# EasyEDA Pro project Archive.eprj, board ALU4.0
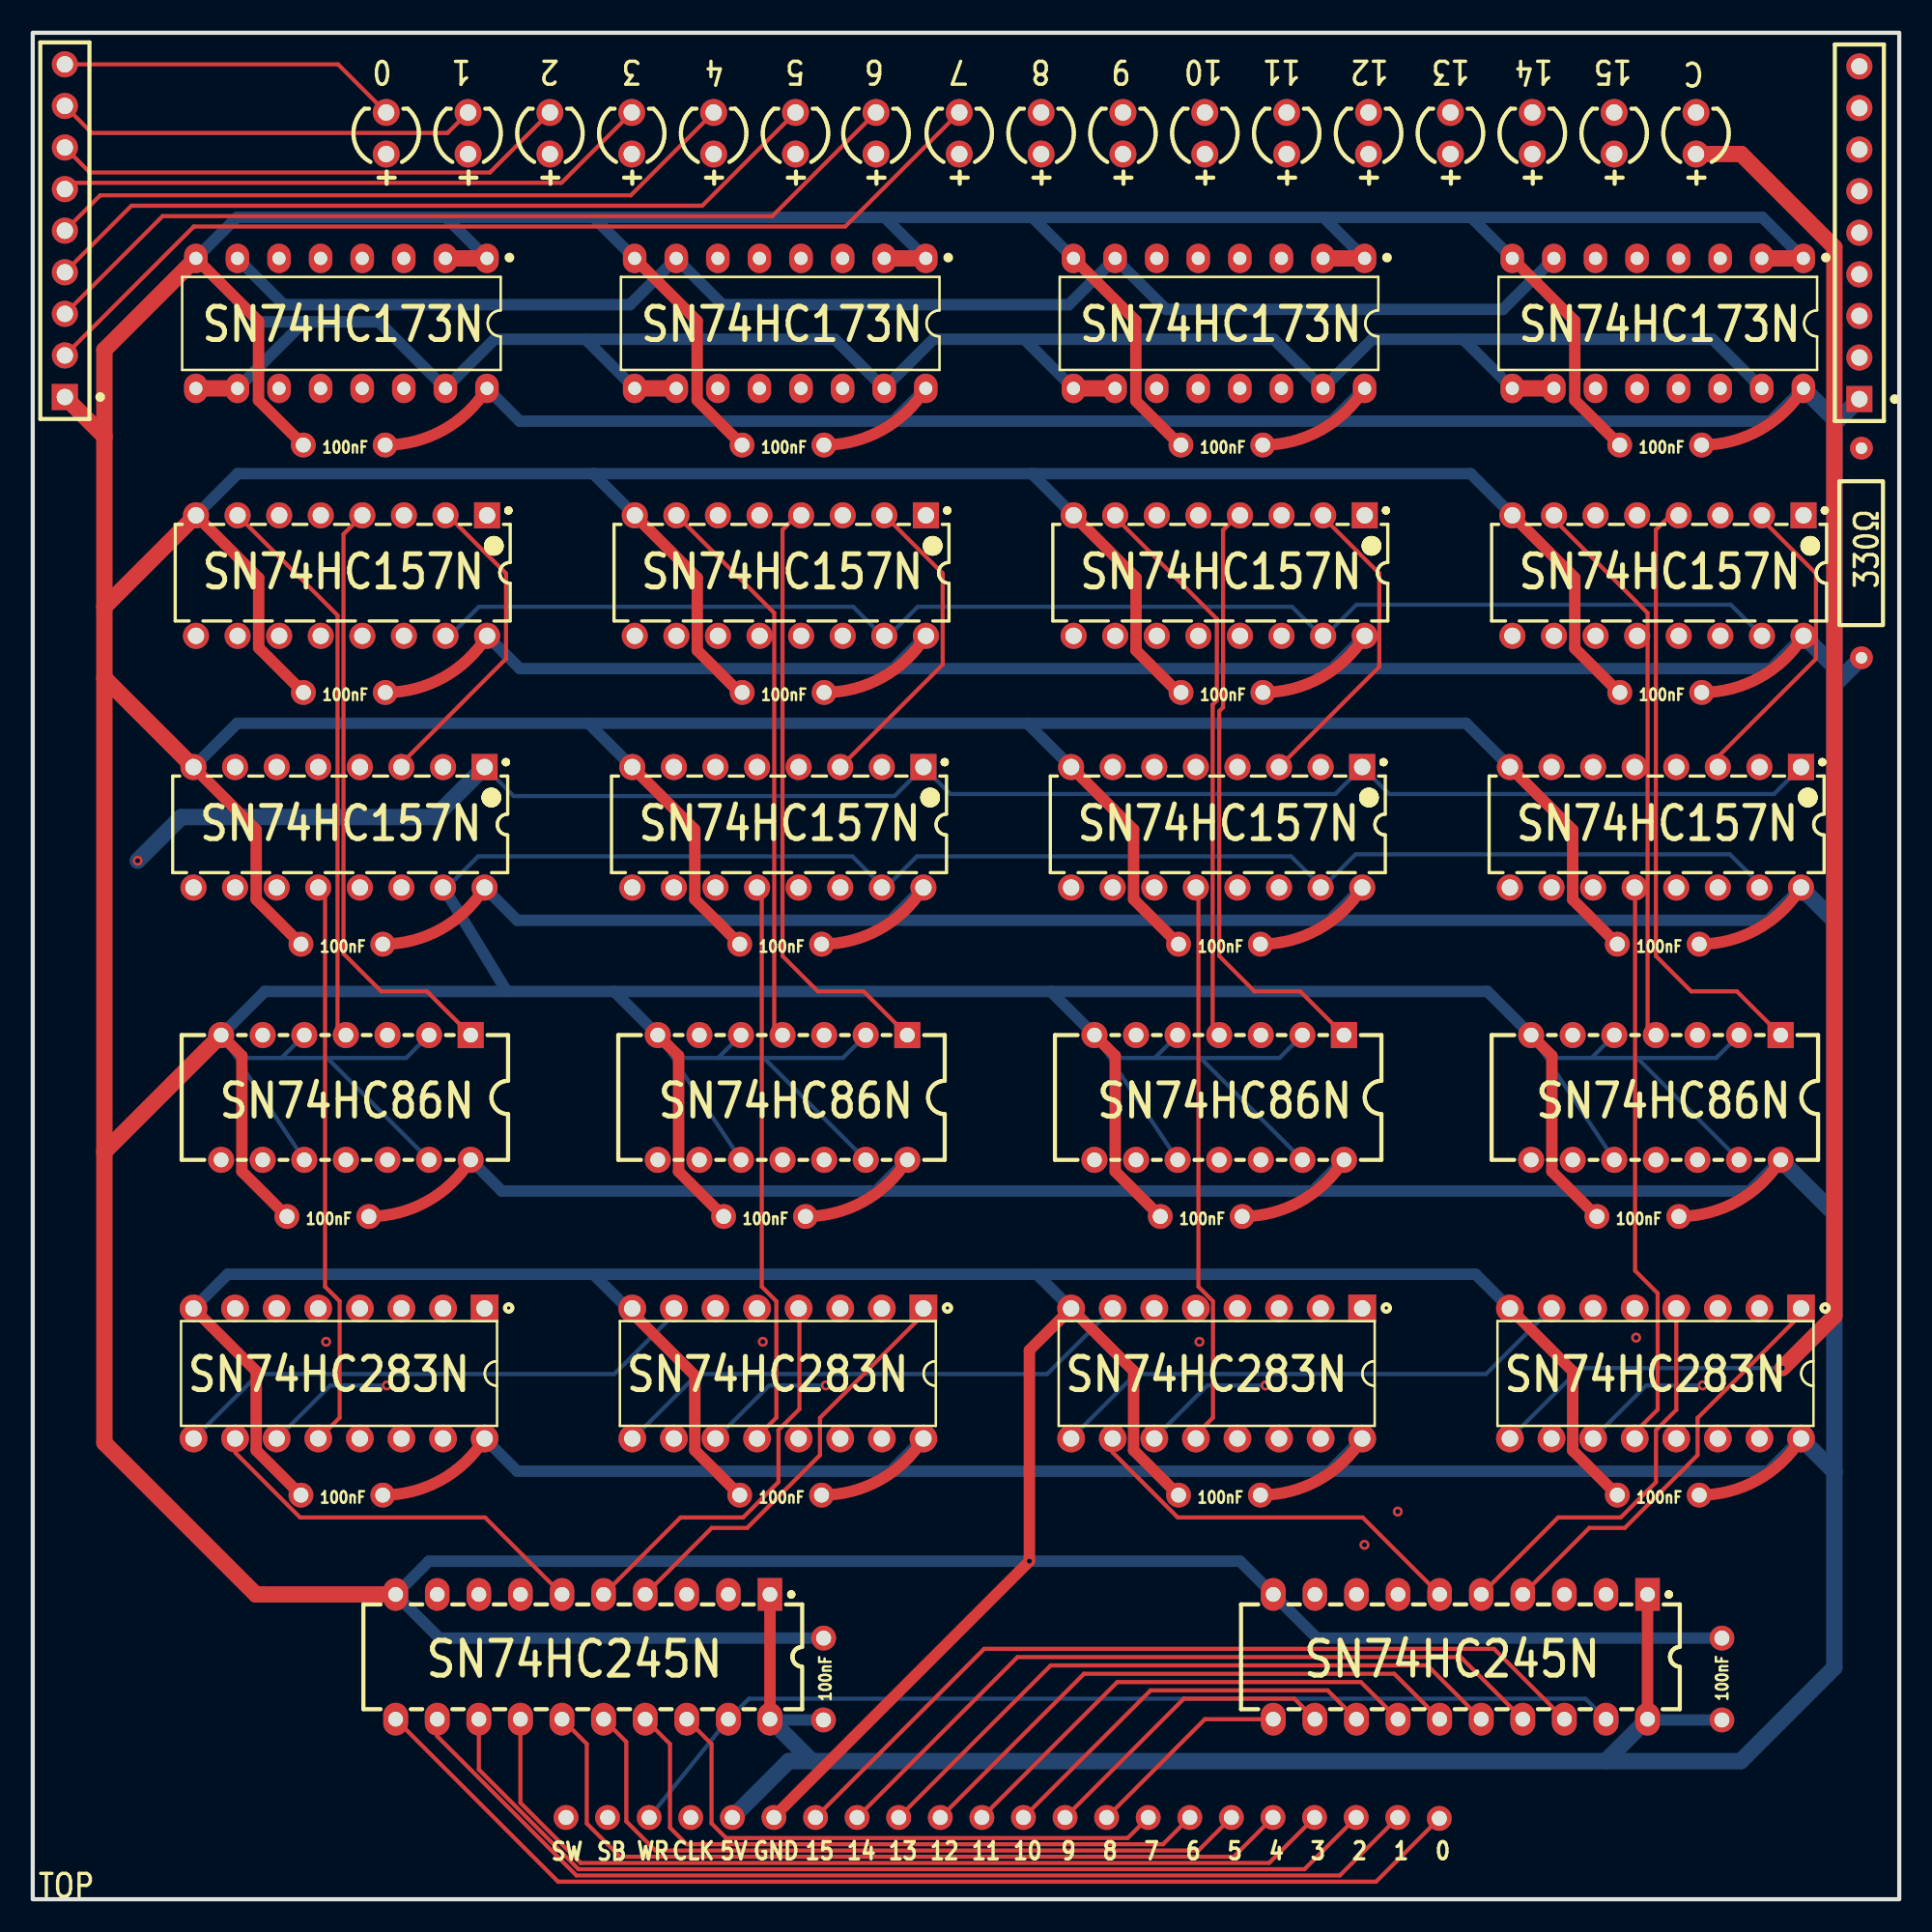
[diagram p18: board, top side]
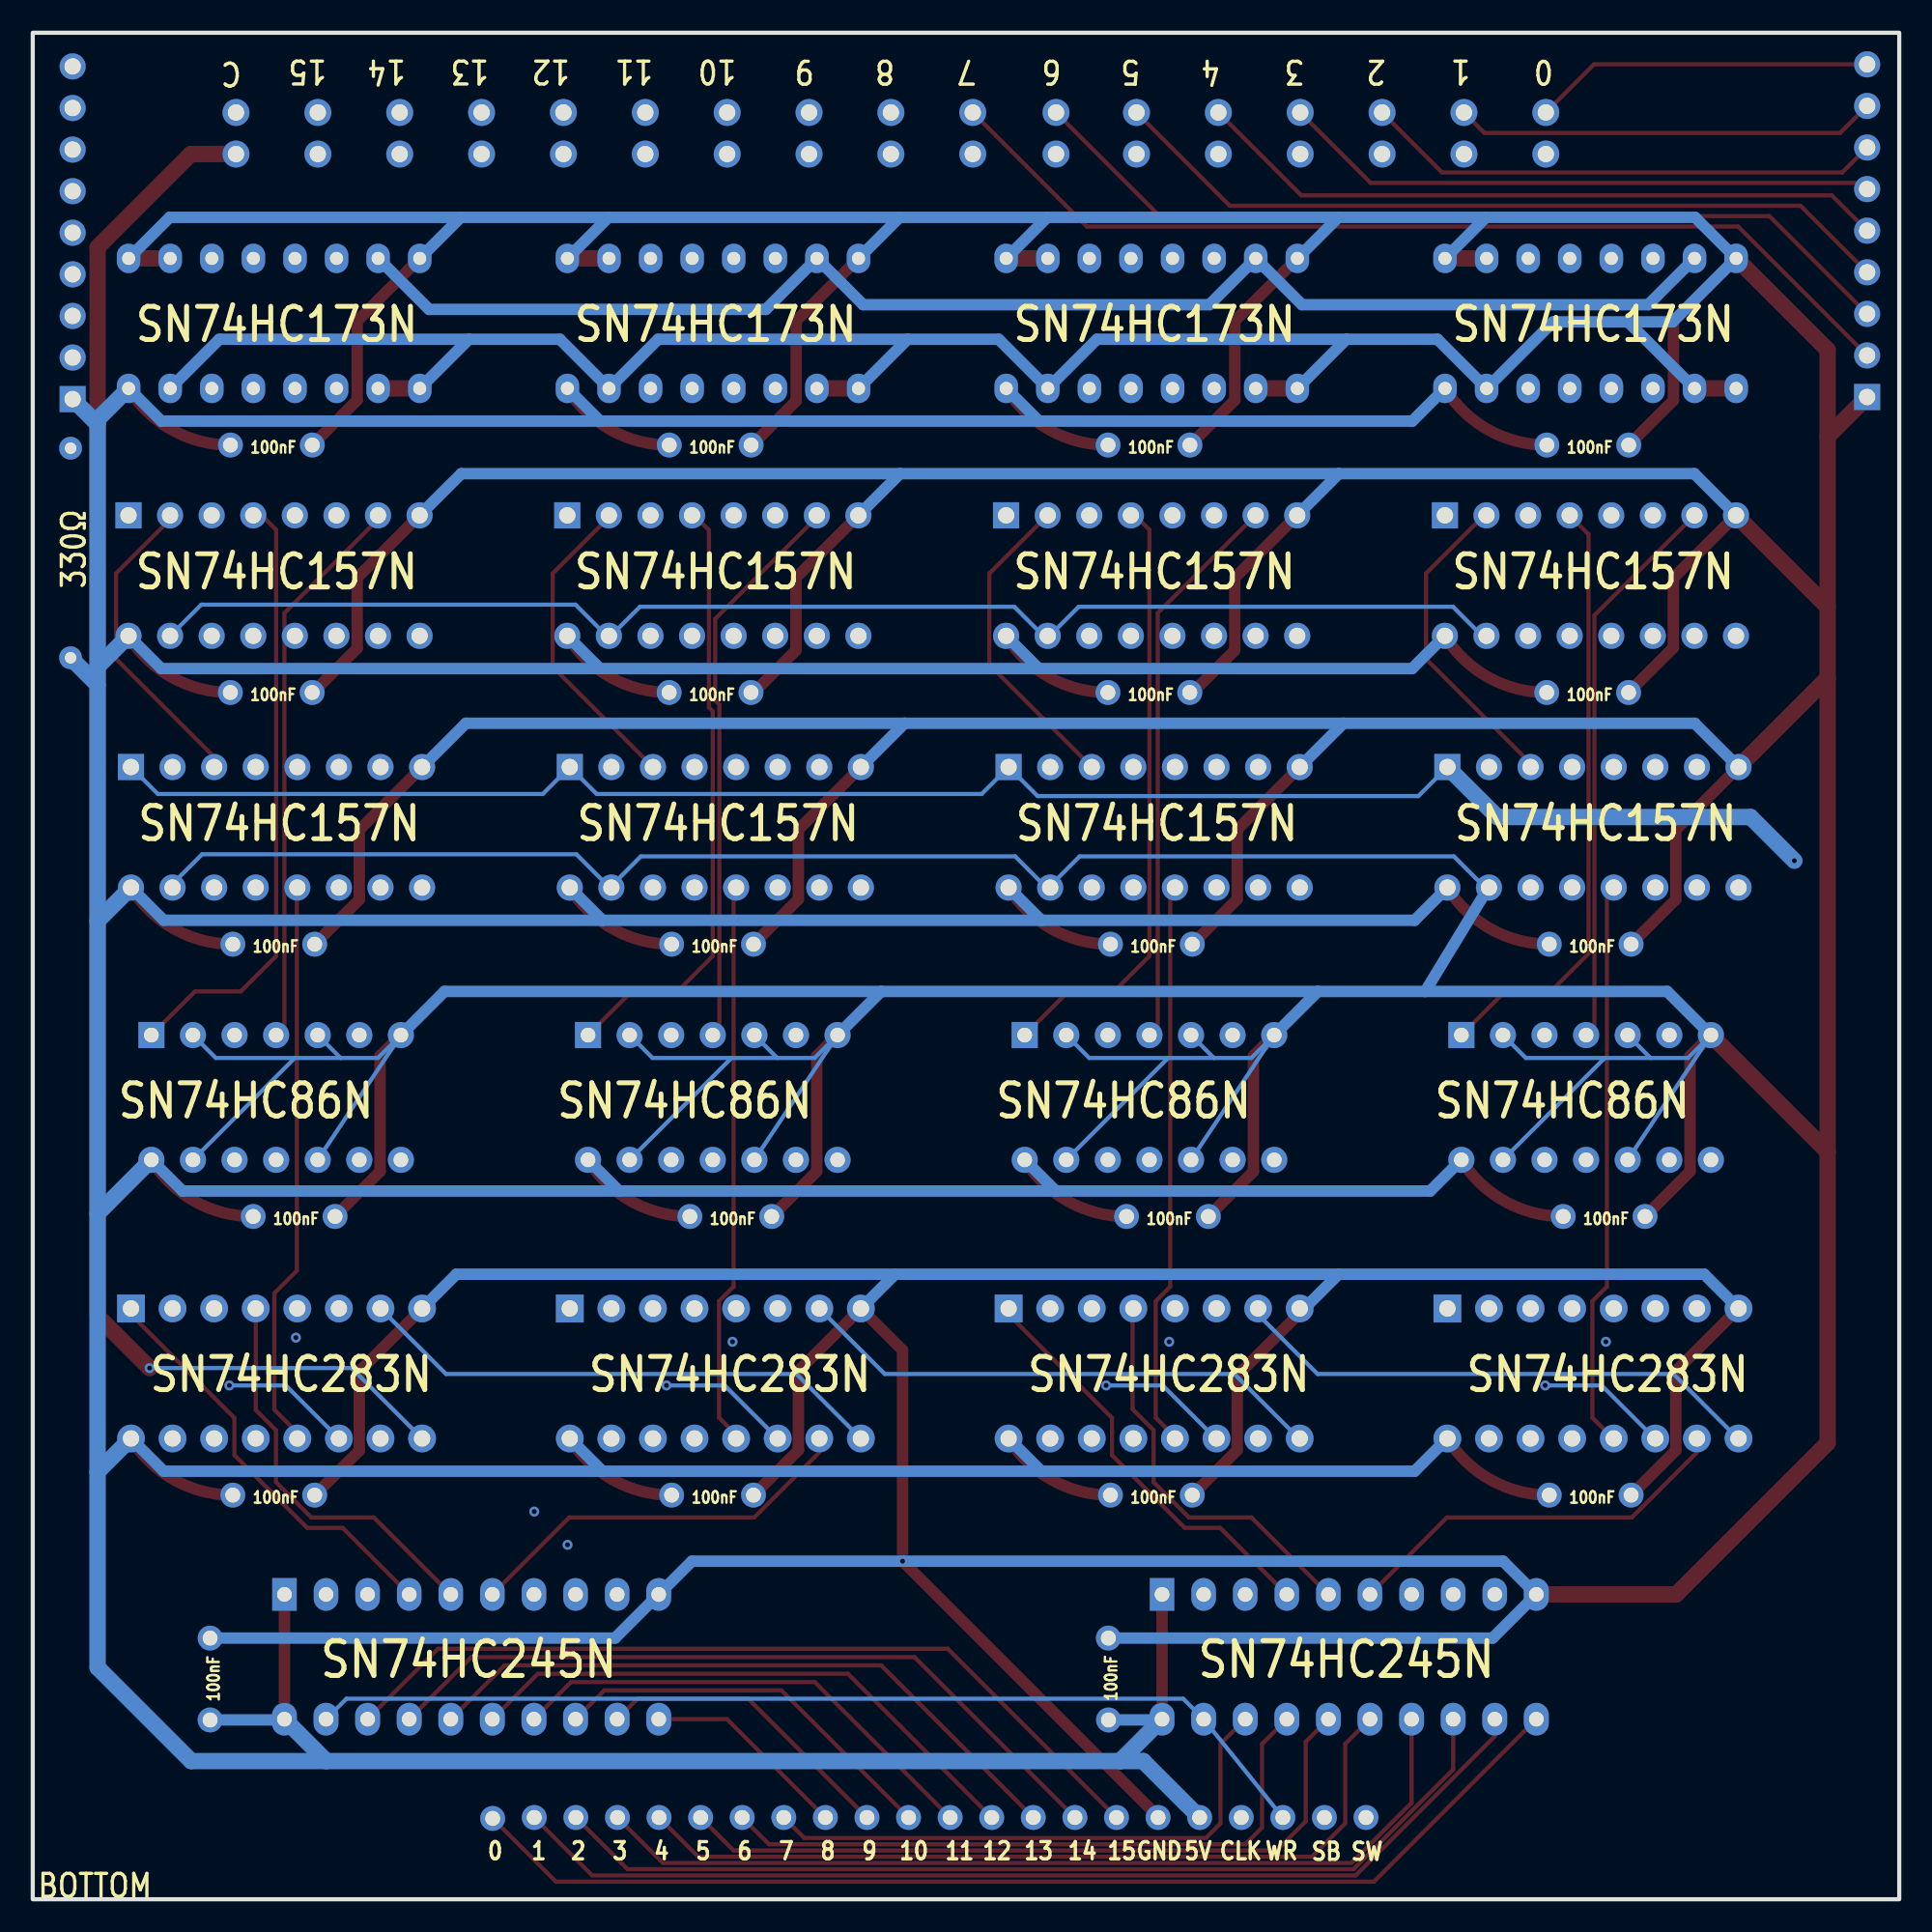
[diagram p19: board, bottom side, seen from below]

Outline 114 x 114 mm; copper layers: Top Layer, Inner1, Inner2, Bottom Layer. Coordinates in mm from the lower left corner of the outline.
Outline path: rectangle 0,114 114,0
Stack: Top Layer 0.035mm / Dielectric1 1.51mm FR4 er 4.5 / Inner1 0.035mm / Dielectric2 0.48mm PP er 4.5 / Inner2 0.035mm / Dielectric3 0.48mm PP er 4.5 / Bottom Layer 0.035mm

## Design rules (mm)
template: JLCPCB Capability(Two Layers Board)
spacing copperThickness1oz (default): track to track 0.102, other pairs 0.152 to 0.3
spacing copperThickness2oz: track to track 0.203, other pairs 0.152 to 0.3
track width copperThickness1oz (default): min 0.127, default 0.254, max 2.54
track width copperThickness2oz: min 0.203, default 0.254, max 2.54
differential pair differentialPair (default): width min 0.127, default 0.254, max 2.54; gap min 0.152, default 0.152
via viaSize (default): diameter min 0.5, default 0.61, max 10; hole min 0.3, default 0.305, max 6.3

## Placement (name value [footprint] x y rotation side)
NOREF  -  [Pad_e1063]  20.53 41.7 270 top
NOREF#2  -  [Pad_e681]  55.43 4.99 90 top
NOREF#3  -  [Pad_e1045]  96.93 73.71 270 top
NOREF#4  -  [Pad_e658]  42.73 4.99 0 top
NOREF#5  -  [Pad_e736]  85.91 4.94 90 top
NOREF#6  -  [Pad_e1047]  96.78 58.33 270 top
NOREF#7  -  [Pad_e1040]  103.17 15.95 0 top
NOREF#8  -  [Pad_e1050]  43.18 24.68 270 top
NOREF#9  -  [Pad_e1046]  96.93 88.82 270 top
NOREF#10  -  [Pad_e1073]  74.98 58.33 270 top
NOREF#11  -  [Pad_e1049]  95.54 41.7 270 top
NOREF#12  -  [Pad_e616]  35.11 4.99 0 top
NOREF#13  -  [Pad_e1055]  48.32 88.82 270 top
NOREF#14  -  [Pad_e1053]  48.3 15.95 180 top
NOREF#15  -  [Pad_e688]  63.05 4.99 90 top
NOREF#16  -  [Pad_e1069]  43.33 73.71 270 top
NOREF#17  -  [Pad_e1071]  43.18 58.33 270 top
NOREF#18  -  [Pad_e1083]  75.13 88.82 270 top
NOREF#19  -  [Pad_e656]  40.19 4.99 0 top
NOREF#20  -  [Pad_e1060]  21.52 88.82 270 top
NOREF#21  -  [Pad_e733]  80.83 4.99 90 top
NOREF#22  -  [Pad_e1054]  48.33 73.71 270 top
NOREF#23  -  [Pad_e1057]  48.18 58.33 270 top
NOREF#24  -  [Pad_e1041]  101.93 73.71 270 top
NOREF#25  -  [Pad_e1072]  74.98 24.68 270 top
NOREF#26  -  [Pad_e1052]  48.29 10.95 0 top
NOREF#27  -  [Pad_e1064]  16.53 73.71 270 top
NOREF#28  -  [Pad_e705]  70.67 4.99 90 top
NOREF#29  -  [Pad_e1074]  73.87 41.7 270 top
NOREF#30  -  [Pad_e1076]  68.87 41.7 270 top
NOREF#31  -  [Pad_e1080]  70.13 88.82 270 top
NOREF#32  -  [Pad_e1082]  75.13 73.71 270 top
NOREF#33  -  [Pad_e1075]  69.98 24.68 270 top
NOREF#34  -  [Pad_e719]  73.21 4.99 90 top
NOREF#35  -  [Pad_e1056]  48.18 24.68 270 top
NOREF#36  -  [Pad_e1065]  16.52 88.82 270 top
NOREF#37  -  [Pad_e1081]  69.98 58.33 270 top
NOREF#38  -  [Pad_e1048]  96.78 24.68 270 top
NOREF#39  -  [Pad_e661]  45.27 4.99 90 top
NOREF#40  -  [Pad_e1044]  100.54 41.7 270 top
NOREF#41  -  [Pad_e1067]  16.38 58.33 270 top
NOREF#42  -  [Pad_e613]  32.57 4.99 0 top
NOREF#43  -  [Pad_e1062]  21.38 58.33 270 top
NOREF#44  -  [Pad_e695]  68.13 4.99 90 top
NOREF#45  -  [Pad_e734]  83.37 4.99 90 top
NOREF#46  -  [Pad_e1070]  43.32 88.82 270 top
NOREF#47  -  [Pad_e1038]  101.78 24.68 270 top
NOREF#48  -  [Pad_e1042]  101.93 88.82 270 top
NOREF#49  -  [Pad_e1058]  47.2 41.7 270 top
NOREF#50  -  [Pad_e1068]  15.53 41.7 270 top
NOREF#51  -  [Pad_e1051]  42.2 41.7 270 top
NOREF#52  -  [Pad_e620]  37.65 4.99 0 top
NOREF#53  -  [Pad_e1043]  101.78 58.33 270 top
NOREF#54  -  [Pad_e1061]  21.38 24.68 270 top
NOREF#55  -  [Pad_e686]  60.51 4.99 90 top
NOREF#56  -  [Pad_e689]  65.59 4.99 90 top
NOREF#57  -  [Pad_e685]  57.97 4.99 90 top
NOREF#58  -  [Pad_e680]  52.89 4.99 90 top
NOREF#59  -  [Pad_e732]  78.29 4.99 90 top
NOREF#60  -  [Pad_e1066]  16.38 24.68 270 top
NOREF#61  -  [Pad_e1079]  70.13 73.71 270 top
NOREF#62  -  [Pad_e664]  47.81 4.99 90 top
NOREF#63  -  [Pad_e676]  50.35 4.99 90 top
NOREF#64  -  [Pad_e1059]  21.53 73.71 270 top
NOREF#65  -  [Pad_e722]  75.75 4.99 90 top
NOREF#66  -  [Pad_e1039]  103.17 10.95 0 top
RN1  -  [RES-ARRAY-TH_9P-P2.54-D1.0]  1.96 101.91 90 top
RN1#2  -  [RES-ARRAY-TH_9P-P2.54-D1.0]  111.56 101.78 90 top
U9  AXIAL-0.4  [RES-TH_BD2.7-L8.8-P12.80-D0.5]  111.69 82.23 90 top
U14  -  [LED-TH_BD4.0-P2.54-FD_RED]  96.59 107.86 90 top
U14#2  -  [LED-TH_BD4.0-P2.54-FD_RED]  91.59 107.86 90 top
U14#3  -  [LED-TH_BD4.0-P2.54-FD_RED]  86.59 107.86 90 top
U14#4  -  [LED-TH_BD4.0-P2.54-FD_RED]  81.59 107.86 90 top
U14#5  -  [LED-TH_BD4.0-P2.54-FD_RED]  76.59 107.86 90 top
U14#6  -  [LED-TH_BD4.0-P2.54-FD_RED]  71.59 107.86 90 top
U14#7  -  [LED-TH_BD4.0-P2.54-FD_RED]  66.59 107.86 90 top
U14#8  -  [LED-TH_BD4.0-P2.54-FD_RED]  56.59 107.86 90 top
U14#9  -  [LED-TH_BD4.0-P2.54-FD_RED]  51.5 107.86 90 top
U14#10  -  [LED-TH_BD4.0-P2.54-FD_RED]  46.59 107.86 90 top
U14#11  -  [LED-TH_BD4.0-P2.54-FD_RED]  41.59 107.86 90 top
U14#12  -  [LED-TH_BD4.0-P2.54-FD_RED]  36.59 107.86 90 top
U14#13  -  [LED-TH_BD4.0-P2.54-FD_RED]  31.59 107.86 90 top
U14#14  -  [LED-TH_BD4.0-P2.54-FD_RED]  26.59 107.86 90 top
U14#15  -  [LED-TH_BD4.0-P2.54-FD_RED]  21.59 107.86 90 top
U14#16  -  [LED-TH_BD4.0-P2.54-FD_RED]  61.59 107.86 90 top
U14#17  -  [LED-TH_BD4.0-P2.54-FD_RED]  101.59 107.86 90 top
U15  -  [DIP-20_L26.8-W6.4-P2.54-LS7.6-BL]  87.2 14.81 180 top
U15#2  -  [DIP-20_L26.8-W6.4-P2.54-LS7.6-BL]  33.6 14.81 180 top
U16  -  [DIP-16_L19.3-W6.4-P2.54-LS7.94-BL]  99.11 32.11 180 top
U16#2  -  [DIP-16_L19.3-W6.4-P2.54-LS7.94-BL]  72.31 32.11 180 top
U16#3  -  [DIP-16_L19.3-W6.4-P2.54-LS7.94-BL]  45.51 32.11 180 top
U16#4  -  [DIP-16_L19.3-W6.4-P2.54-LS7.94-BL]  18.71 32.11 180 top
U17  -  [DIP-14_L20.0-W7.6-P2.54-LS8.0-BL]  99.14 48.97 180 top
U17#2  -  [DIP-14_L20.0-W7.6-P2.54-LS8.0-BL]  72.47 48.97 180 top
U17#3  -  [DIP-14_L20.0-W7.6-P2.54-LS8.0-BL]  45.8 48.97 180 top
U17#4  -  [DIP-14_L20.0-W7.6-P2.54-LS8.0-BL]  19.13 48.97 180 top
U18  -  [DIP-16_L20.4-W5.8-P2.54-LS7.6-BL]  99.11 65.47 180 top
U18#2  -  [DIP-16_L20.4-W5.8-P2.54-LS7.6-BL]  72.31 65.47 180 top
U18#3  -  [DIP-16_L20.4-W5.8-P2.54-LS7.6-BL]  45.51 65.47 180 top
U18#4  -  [DIP-16_L20.4-W5.8-P2.54-LS7.6-BL]  18.71 65.47 180 top
U18#5  -  [DIP-16_L20.4-W5.8-P2.54-LS7.6-BL]  72.46 80.84 180 top
U18#6  -  [DIP-16_L20.4-W5.8-P2.54-LS7.6-BL]  99.26 80.84 180 top
U18#7  -  [DIP-16_L20.4-W5.8-P2.54-LS7.6-BL]  45.66 80.84 180 top
U18#8  -  [DIP-16_L20.4-W5.8-P2.54-LS7.6-BL]  18.86 80.84 180 top
U19  -  [PDIP-16_L19.3-W6.4-P2.54-LS7.94-BL]  18.85 96.25 180 top
U19#2  -  [PDIP-16_L19.3-W6.4-P2.54-LS7.94-BL]  45.65 96.25 180 top
U19#3  -  [PDIP-16_L19.3-W6.4-P2.54-LS7.94-BL]  72.45 96.25 180 top
U19#4  -  [PDIP-16_L19.3-W6.4-P2.54-LS7.94-BL]  99.25 96.25 180 top

## Footprints (pads in the part's own frame, mm; a bottom-side part is the same pattern mirrored in y, then rotated)
DIP-14_L20.0-W7.6-P2.54-LS8.0-BL
  rect 1.6x1.6 hole 0.9: 1(-7.62,-3.81)
  round 1.6 hole 0.9: 2(-5.08,-3.81) 3(-2.54,-3.81) 4(0,-3.81) 5(2.54,-3.81) 6(5.08,-3.81) 7(7.62,-3.81) 8(7.62,3.81) 9(5.08,3.81) 10(2.54,3.81) 11(0,3.81) 12(-2.54,3.81) 13(-5.08,3.81) 14(-7.62,3.81)
DIP-16_L19.3-W6.4-P2.54-LS7.94-BL
  rect 1.7x1.7 hole 1: 1(-8.89,-3.97)
  round 1.7 hole 1: 2(-6.35,-3.97) 3(-3.81,-3.97) 4(-1.27,-3.97) 5(1.27,-3.97) 6(3.81,-3.97) 7(6.35,-3.97) 8(8.89,-3.97) 9(8.89,3.97) 10(6.35,3.97) 11(3.81,3.97) 12(1.27,3.97) 13(-1.27,3.97) 14(-3.81,3.97) 15(-6.35,3.97) 16(-8.89,3.97)
DIP-16_L20.4-W5.8-P2.54-LS7.6-BL
  rect 1.6x1.6 hole 1: 1(-8.89,-3.68)
  round 1.6 hole 1: 2(-6.35,-3.68) 3(-3.81,-3.68) 4(-1.27,-3.68) 5(1.27,-3.68) 6(3.81,-3.68) 7(6.35,-3.68) 8(8.89,-3.68) 9(8.89,3.68) 10(6.35,3.68) 11(3.81,3.68) 12(1.27,3.68) 13(-1.27,3.68) 14(-3.81,3.68) 15(-6.35,3.68) 16(-8.89,3.68)
DIP-20_L26.8-W6.4-P2.54-LS7.6-BL
  rect 1.5x2 hole 0.9: 1(-11.43,-3.81)
  oval 1.5x2 hole 0.9: 2(-8.89,-3.81) 3(-6.35,-3.81) 4(-3.81,-3.81) 5(-1.27,-3.81) 6(1.27,-3.81) 7(3.81,-3.81) 8(6.35,-3.81) 9(8.89,-3.81)
  oval 1.524x2 hole 0.9: 10(11.43,-3.81) 11(11.43,3.81) 12(8.89,3.81) 13(6.35,3.81) 14(3.81,3.81) 15(1.27,3.81) 16(-1.27,3.81) 17(-3.81,3.81) 18(-6.35,3.81) 19(-8.89,3.81) 20(-11.43,3.81)
LED-TH_BD4.0-P2.54-FD_RED
  round 1.651 hole 1: 1(-1.27,0) 2(1.27,0)
Pad_e613
  round 1.524 hole 0.914: 22(0,0)
Pad_e616
  round 1.524 hole 0.914: 21(0,0)
Pad_e620
  round 1.524 hole 0.914: 20(0,0)
Pad_e656
  round 1.524 hole 0.914: 19(0,0)
Pad_e658
  round 1.524 hole 0.914: 18(0,0)
Pad_e661
  round 1.524 hole 0.914: 17(0,0)
Pad_e664
  round 1.524 hole 0.914: 16(0,0)
Pad_e676
  round 1.524 hole 0.914: 15(0,0)
Pad_e680
  round 1.524 hole 0.914: 14(0,0)
Pad_e681
  round 1.524 hole 0.914: 13(0,0)
Pad_e685
  round 1.524 hole 0.914: 12(0,0)
Pad_e686
  round 1.524 hole 0.914: 11(0,0)
Pad_e688
  round 1.524 hole 0.914: 10(0,0)
Pad_e689
  round 1.524 hole 0.914: 9(0,0)
Pad_e695
  round 1.524 hole 0.914: 8(0,0)
Pad_e705
  round 1.524 hole 0.914: 7(0,0)
Pad_e719
  round 1.524 hole 0.914: 6(0,0)
Pad_e722
  round 1.524 hole 0.914: 5(0,0)
Pad_e732
  round 1.524 hole 0.914: 4(0,0)
Pad_e733
  round 1.524 hole 0.914: 3(0,0)
Pad_e734
  round 1.524 hole 0.914: 2(0,0)
Pad_e736
  round 1.524 hole 0.914: 1(0,0)
Pad_e1038
  round 1.524 hole 0.914: 2(0,0)
Pad_e1039
  round 1.524 hole 0.914: 2(0,0)
Pad_e1040
  round 1.524 hole 0.914: 1(0,0)
Pad_e1041
  round 1.524 hole 0.914: 2(0,0)
Pad_e1042
  round 1.524 hole 0.914: 2(0,0)
Pad_e1043
  round 1.524 hole 0.914: 2(0,0)
Pad_e1044
  round 1.524 hole 0.914: 2(0,0)
Pad_e1045
  round 1.524 hole 0.914: 1(0,0)
Pad_e1046
  round 1.524 hole 0.914: 1(0,0)